# Altium schematic sheet v6_mgt.SchDoc: Virtex-6 MGT Interfaces
size A3; Date: DO NOT USE, RATHER USE PROJ OPTIONS; DrawnBy: DO NOT USE, RATHER USE PROJ OPTIONS; Engineer: DO NOT USE, RATHER USE PROJ OPTIONS; Organization: DO NOT USE, RATHER USE PROJ OPTIONS; DocumentNumber: DO NOT USE, RATHER USE PROJ OPTIONS; Revision: DO NOT USE, RATHER USE PROJ OPTIONS; SheetNumber: 18; SheetTotal: 29; SCH_Sheet_Filename: v6_mgt.SchDoc; CurrentTime: DO NOT USE, RATHER USE PROJ OPTIONS; Time: DO NOT USE, RATHER USE PROJ OPTIONS; DocumentFullPathAndName: DO NOT USE, RATHER USE PROJ OPTIONS; DocumentName: DO NOT USE, RATHER USE PROJ OPTIONS; ModifiedDate: DO NOT USE, RATHER USE PROJ OPTIONS; ImagePath: DO NOT USE, RATHER USE PROJ OPTIONS
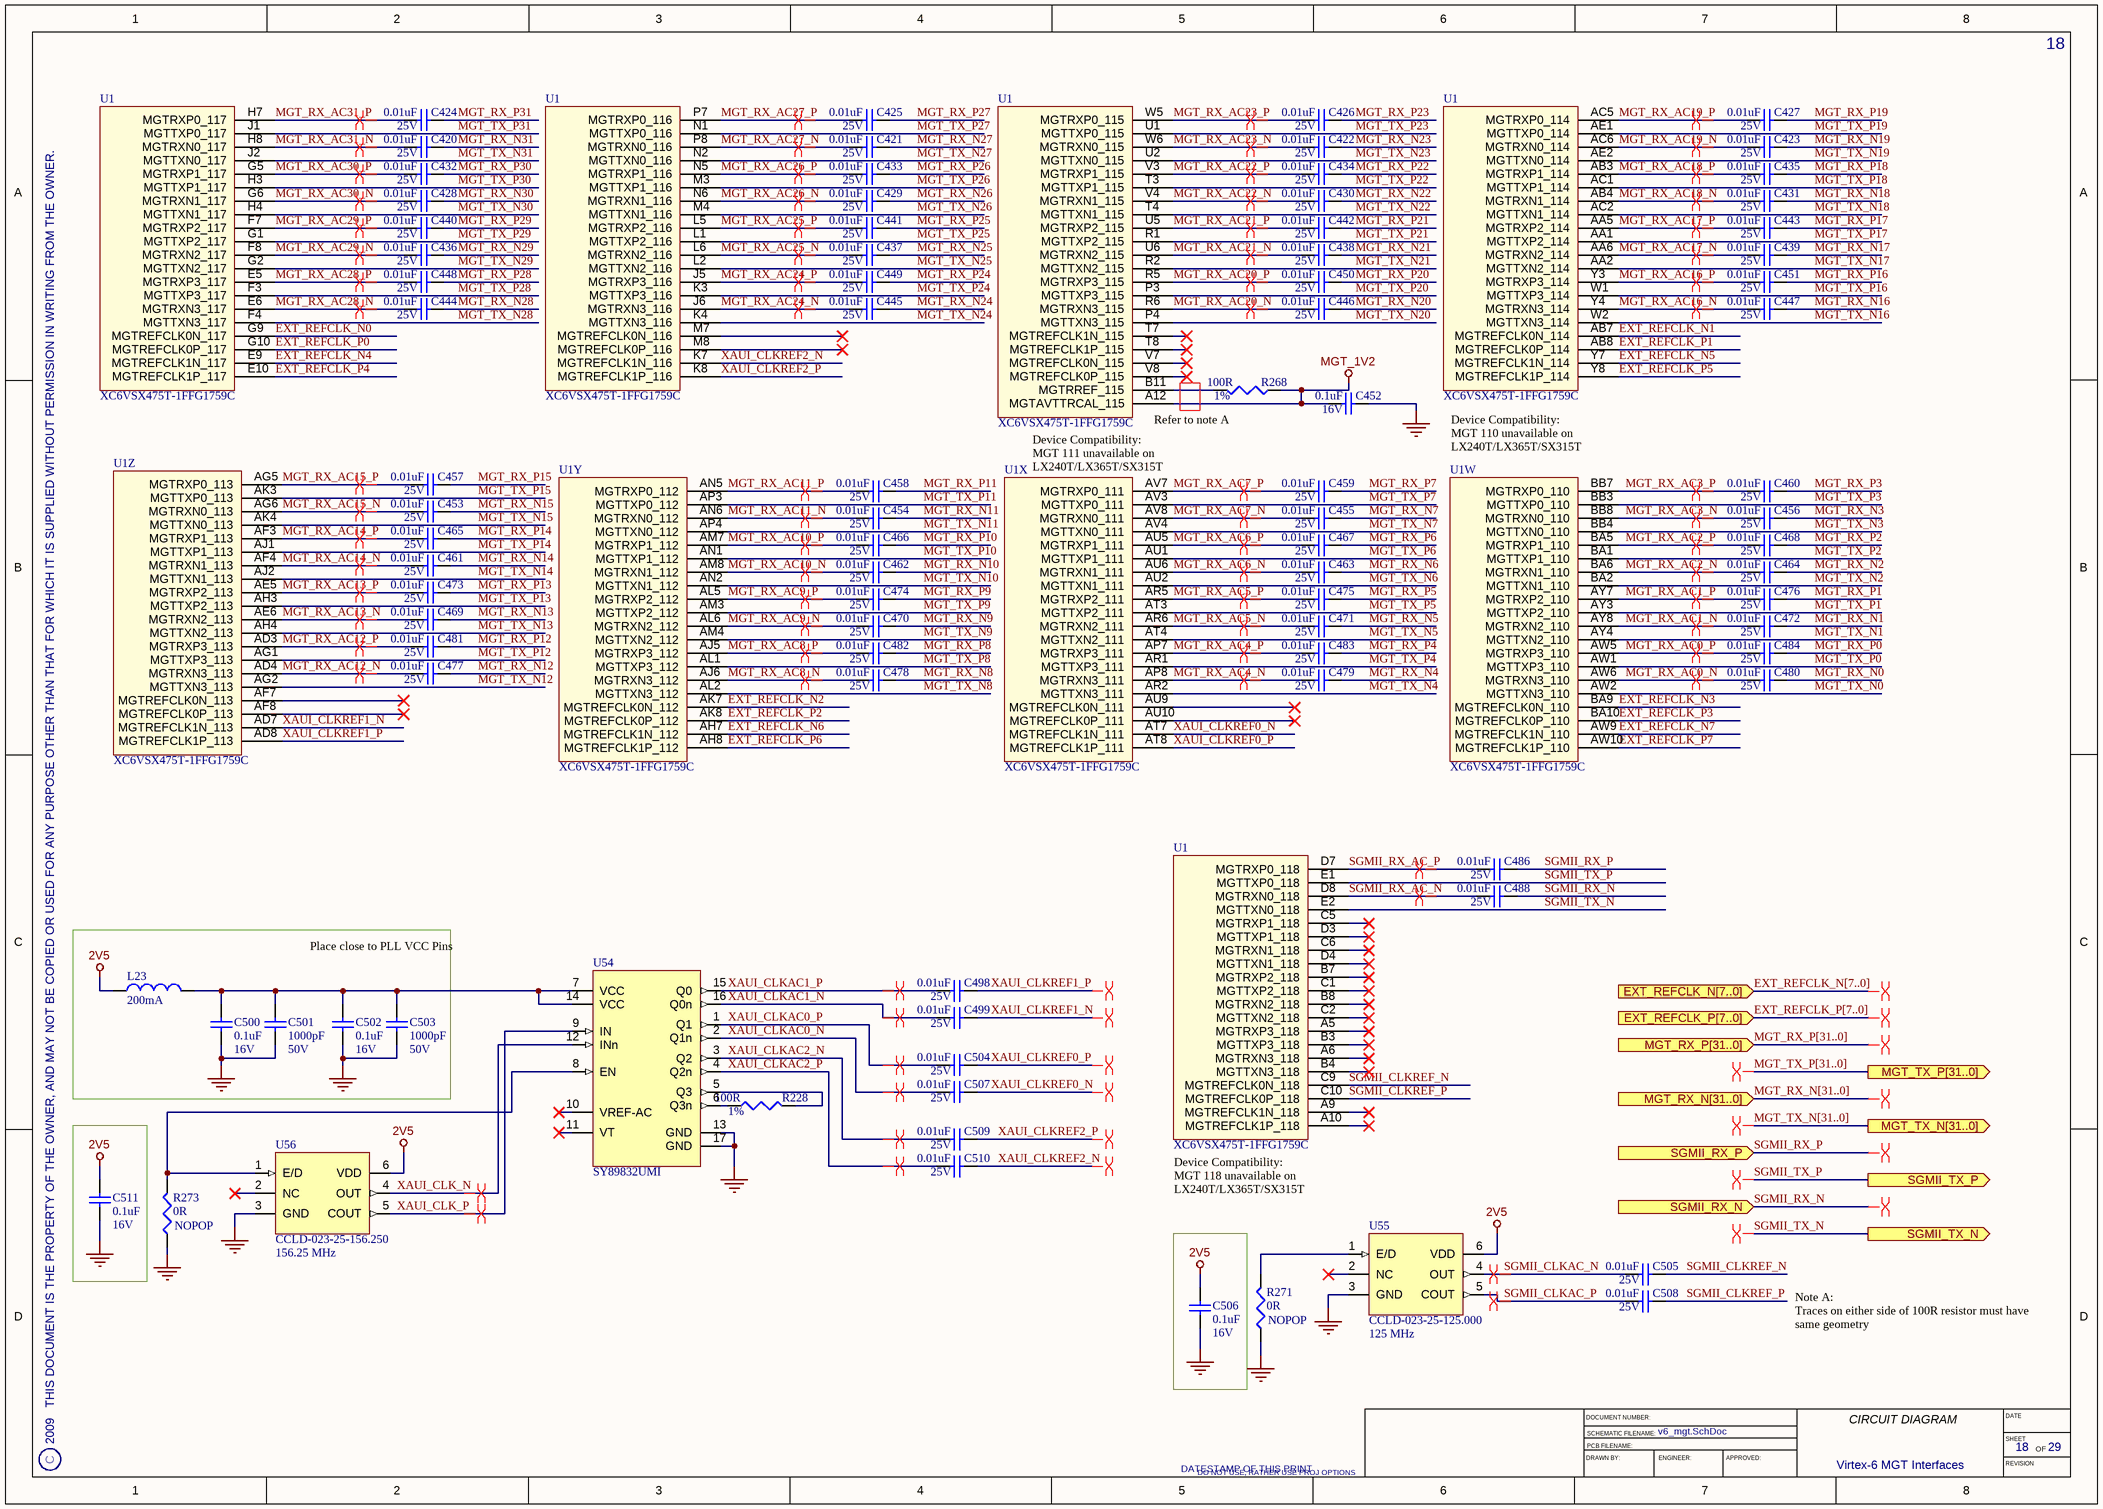
[diagram p0: v6_mgt.SchDoc]

## Parts
C420  Rating: 25V  [CAPC1005X55L]  (hidden comment: 0.01uF)
C421  Rating: 25V  [CAPC1005X55L]  (hidden comment: 0.01uF)
C422  Rating: 25V  [CAPC1005X55L]  (hidden comment: 0.01uF)
C423  Rating: 25V  [CAPC1005X55L]  (hidden comment: 0.01uF)
C424  Rating: 25V  [CAPC1005X55L]  (hidden comment: 0.01uF)
C425  Rating: 25V  [CAPC1005X55L]  (hidden comment: 0.01uF)
C426  Rating: 25V  [CAPC1005X55L]  (hidden comment: 0.01uF)
C427  Rating: 25V  [CAPC1005X55L]  (hidden comment: 0.01uF)
C428  Rating: 25V  [CAPC1005X55L]  (hidden comment: 0.01uF)
C429  Rating: 25V  [CAPC1005X55L]  (hidden comment: 0.01uF)
C430  Rating: 25V  [CAPC1005X55L]  (hidden comment: 0.01uF)
C431  Rating: 25V  [CAPC1005X55L]  (hidden comment: 0.01uF)
C432  Rating: 25V  [CAPC1005X55L]  (hidden comment: 0.01uF)
C433  Rating: 25V  [CAPC1005X55L]  (hidden comment: 0.01uF)
C434  Rating: 25V  [CAPC1005X55L]  (hidden comment: 0.01uF)
C435  Rating: 25V  [CAPC1005X55L]  (hidden comment: 0.01uF)
C436  Rating: 25V  [CAPC1005X55L]  (hidden comment: 0.01uF)
C437  Rating: 25V  [CAPC1005X55L]  (hidden comment: 0.01uF)
C438  Rating: 25V  [CAPC1005X55L]  (hidden comment: 0.01uF)
C439  Rating: 25V  [CAPC1005X55L]  (hidden comment: 0.01uF)
C440  Rating: 25V  [CAPC1005X55L]  (hidden comment: 0.01uF)
C441  Rating: 25V  [CAPC1005X55L]  (hidden comment: 0.01uF)
C442  Rating: 25V  [CAPC1005X55L]  (hidden comment: 0.01uF)
C443  Rating: 25V  [CAPC1005X55L]  (hidden comment: 0.01uF)
C444  Rating: 25V  [CAPC1005X55L]  (hidden comment: 0.01uF)
C445  Rating: 25V  [CAPC1005X55L]  (hidden comment: 0.01uF)
C446  Rating: 25V  [CAPC1005X55L]  (hidden comment: 0.01uF)
C447  Rating: 25V  [CAPC1005X55L]  (hidden comment: 0.01uF)
C448  Rating: 25V  [CAPC1005X55L]  (hidden comment: 0.01uF)
C449  Rating: 25V  [CAPC1005X55L]  (hidden comment: 0.01uF)
C450  Rating: 25V  [CAPC1005X55L]  (hidden comment: 0.01uF)
C451  Rating: 25V  [CAPC1005X55L]  (hidden comment: 0.01uF)
C452  Rating: 16V  [CAPC1005X60L]  (hidden comment: 0.1uF)
C453  Rating: 25V  [CAPC1005X55L]  (hidden comment: 0.01uF)
C454  Rating: 25V  [CAPC1005X55L]  (hidden comment: 0.01uF)
C455  Rating: 25V  [CAPC1005X55L]  (hidden comment: 0.01uF)
C456  Rating: 25V  [CAPC1005X55L]  (hidden comment: 0.01uF)
C457  Rating: 25V  [CAPC1005X55L]  (hidden comment: 0.01uF)
C458  Rating: 25V  [CAPC1005X55L]  (hidden comment: 0.01uF)
C459  Rating: 25V  [CAPC1005X55L]  (hidden comment: 0.01uF)
C460  Rating: 25V  [CAPC1005X55L]  (hidden comment: 0.01uF)
C461  Rating: 25V  [CAPC1005X55L]  (hidden comment: 0.01uF)
C462  Rating: 25V  [CAPC1005X55L]  (hidden comment: 0.01uF)
C463  Rating: 25V  [CAPC1005X55L]  (hidden comment: 0.01uF)
C464  Rating: 25V  [CAPC1005X55L]  (hidden comment: 0.01uF)
C465  Rating: 25V  [CAPC1005X55L]  (hidden comment: 0.01uF)
C466  Rating: 25V  [CAPC1005X55L]  (hidden comment: 0.01uF)
C467  Rating: 25V  [CAPC1005X55L]  (hidden comment: 0.01uF)
C468  Rating: 25V  [CAPC1005X55L]  (hidden comment: 0.01uF)
C469  Rating: 25V  [CAPC1005X55L]  (hidden comment: 0.01uF)
C470  Rating: 25V  [CAPC1005X55L]  (hidden comment: 0.01uF)
C471  Rating: 25V  [CAPC1005X55L]  (hidden comment: 0.01uF)
C472  Rating: 25V  [CAPC1005X55L]  (hidden comment: 0.01uF)
C473  Rating: 25V  [CAPC1005X55L]  (hidden comment: 0.01uF)
C474  Rating: 25V  [CAPC1005X55L]  (hidden comment: 0.01uF)
C475  Rating: 25V  [CAPC1005X55L]  (hidden comment: 0.01uF)
C476  Rating: 25V  [CAPC1005X55L]  (hidden comment: 0.01uF)
C477  Rating: 25V  [CAPC1005X55L]  (hidden comment: 0.01uF)
C478  Rating: 25V  [CAPC1005X55L]  (hidden comment: 0.01uF)
C479  Rating: 25V  [CAPC1005X55L]  (hidden comment: 0.01uF)
C480  Rating: 25V  [CAPC1005X55L]  (hidden comment: 0.01uF)
C481  Rating: 25V  [CAPC1005X55L]  (hidden comment: 0.01uF)
C482  Rating: 25V  [CAPC1005X55L]  (hidden comment: 0.01uF)
C483  Rating: 25V  [CAPC1005X55L]  (hidden comment: 0.01uF)
C484  Rating: 25V  [CAPC1005X55L]  (hidden comment: 0.01uF)
C486  Rating: 25V  [CAPC1005X55L]  (hidden comment: 0.01uF)
C488  Rating: 25V  [CAPC1005X55L]  (hidden comment: 0.01uF)
C498  Rating: 25V  [CAPC1005X55L]  (hidden comment: 0.01uF)
C499  Rating: 25V  [CAPC1005X55L]  (hidden comment: 0.01uF)
C500  Rating: 16V  [CAPC1005X60L]  (hidden comment: 0.1uF)
C501  Rating: 50V  [CAPC1005X55L]  (hidden comment: 1000pF)
C502  Rating: 16V  [CAPC1005X60L]  (hidden comment: 0.1uF)
C503  Rating: 50V  [CAPC1005X55L]  (hidden comment: 1000pF)
C504  Rating: 25V  [CAPC1005X55L]  (hidden comment: 0.01uF)
C505  Rating: 25V  [CAPC1005X55L]  (hidden comment: 0.01uF)
C506  Rating: 16V  [CAPC1005X60L]  (hidden comment: 0.1uF)
C507  Rating: 25V  [CAPC1005X55L]  (hidden comment: 0.01uF)
C508  Rating: 25V  [CAPC1005X55L]  (hidden comment: 0.01uF)
C509  Rating: 25V  [CAPC1005X55L]  (hidden comment: 0.01uF)
C510  Rating: 25V  [CAPC1005X55L]  (hidden comment: 0.01uF)
C511  Rating: 16V  [CAPC1005X60L]  (hidden comment: 0.1uF)
L23  Rating: 200mA  [INDC2012X130L]  (hidden comment: 600R)
R228  Tolerance: 1%  [RESC1005X40L]  (hidden comment: 100R)
R268  Tolerance: 1%  [RESC1005X40L]  (hidden comment: 100R)
R271  0R  [RESC1005X40L]
R273  0R  [RESC1005X40L]
U1  XC6VSX475T-1FFG1759C  [FFG1759]  (parts W,X,Y,Z,27,28,29,30,31 of 39)
U54  SY89832UMI  [MLF-16]
U55  Frequency: 125 MHz  [CCLD-023X-XX-XXX_XXX]  (hidden comment: CCLD-023-25-125.000)
U56  Frequency: 156.25 MHz  [CCLD-023X-XX-XXX_XXX]  (hidden comment: CCLD-023-25-156.250)

## Ports
EXT_REFCLK_N[7..0] (in), EXT_REFCLK_P[7..0] (in), MGT_RX_N[31..0] (in), MGT_RX_P[31..0] (in), MGT_TX_N[31..0] (out), MGT_TX_P[31..0] (out), SGMII_RX_N (in), SGMII_RX_P (in), SGMII_TX_N (out), SGMII_TX_P (out)

## Nets
2V5: C506.2 C511.2 L23.1 U55.6(VDD) U56.6(VDD)
GND: C452.1 C500.1 C501.1 C502.1 C503.1 C506.1 C511.1 R271.1 R273.1 U54.13(GND) U54.17(GND) U55.3(GND) U56.3(GND)
MGT_1V2: C452.2 R268.1 U1.A12(MGTAVTTRCAL_115)
EXT_REFCLK_N0: U1.G9(MGTREFCLK0N_117)
EXT_REFCLK_N1: U1.AB7(MGTREFCLK0N_114)
EXT_REFCLK_N2: U1.AK7(MGTREFCLK0N_112)
EXT_REFCLK_N3: U1.BA9(MGTREFCLK0N_110)
EXT_REFCLK_N4: U1.E9(MGTREFCLK1N_117)
EXT_REFCLK_N5: U1.Y7(MGTREFCLK1N_114)
EXT_REFCLK_N6: U1.AH7(MGTREFCLK1N_112)
EXT_REFCLK_N7: U1.AW9(MGTREFCLK1N_110)
EXT_REFCLK_P0: U1.G10(MGTREFCLK0P_117)
EXT_REFCLK_P1: U1.AB8(MGTREFCLK0P_114)
EXT_REFCLK_P2: U1.AK8(MGTREFCLK0P_112)
EXT_REFCLK_P3: U1.BA10(MGTREFCLK0P_110)
EXT_REFCLK_P4: U1.E10(MGTREFCLK1P_117)
EXT_REFCLK_P5: U1.Y8(MGTREFCLK1P_114)
EXT_REFCLK_P6: U1.AH8(MGTREFCLK1P_112)
EXT_REFCLK_P7: U1.AW10(MGTREFCLK1P_110)
MGT_RX_AC0_N: C480.1 U1.AW6(MGTRXN3_110)
MGT_RX_AC0_P: C484.1 U1.AW5(MGTRXP3_110)
MGT_RX_AC1_N: C472.1 U1.AY8(MGTRXN2_110)
MGT_RX_AC1_P: C476.1 U1.AY7(MGTRXP2_110)
MGT_RX_AC2_N: C464.1 U1.BA6(MGTRXN1_110)
MGT_RX_AC2_P: C468.1 U1.BA5(MGTRXP1_110)
MGT_RX_AC3_N: C456.1 U1.BB8(MGTRXN0_110)
MGT_RX_AC3_P: C460.1 U1.BB7(MGTRXP0_110)
MGT_RX_AC4_N: C479.1 U1.AP8(MGTRXN3_111)
MGT_RX_AC4_P: C483.1 U1.AP7(MGTRXP3_111)
MGT_RX_AC5_N: C471.1 U1.AR6(MGTRXN2_111)
MGT_RX_AC5_P: C475.1 U1.AR5(MGTRXP2_111)
MGT_RX_AC6_N: C463.1 U1.AU6(MGTRXN1_111)
MGT_RX_AC6_P: C467.1 U1.AU5(MGTRXP1_111)
MGT_RX_AC7_N: C455.1 U1.AV8(MGTRXN0_111)
MGT_RX_AC7_P: C459.1 U1.AV7(MGTRXP0_111)
MGT_RX_AC8_N: C478.1 U1.AJ6(MGTRXN3_112)
MGT_RX_AC8_P: C482.1 U1.AJ5(MGTRXP3_112)
MGT_RX_AC9_N: C470.1 U1.AL6(MGTRXN2_112)
MGT_RX_AC9_P: C474.1 U1.AL5(MGTRXP2_112)
MGT_RX_AC10_N: C462.1 U1.AM8(MGTRXN1_112)
MGT_RX_AC10_P: C466.1 U1.AM7(MGTRXP1_112)
MGT_RX_AC11_N: C454.1 U1.AN6(MGTRXN0_112)
MGT_RX_AC11_P: C458.1 U1.AN5(MGTRXP0_112)
MGT_RX_AC12_N: C477.1 U1.AD4(MGTRXN3_113)
MGT_RX_AC12_P: C481.1 U1.AD3(MGTRXP3_113)
MGT_RX_AC13_N: C469.1 U1.AE6(MGTRXN2_113)
MGT_RX_AC13_P: C473.1 U1.AE5(MGTRXP2_113)
MGT_RX_AC14_N: C461.1 U1.AF4(MGTRXN1_113)
MGT_RX_AC14_P: C465.1 U1.AF3(MGTRXP1_113)
MGT_RX_AC15_N: C453.1 U1.AG6(MGTRXN0_113)
MGT_RX_AC15_P: C457.1 U1.AG5(MGTRXP0_113)
MGT_RX_AC16_N: C447.1 U1.Y4(MGTRXN3_114)
MGT_RX_AC16_P: C451.1 U1.Y3(MGTRXP3_114)
MGT_RX_AC17_N: C439.1 U1.AA6(MGTRXN2_114)
MGT_RX_AC17_P: C443.1 U1.AA5(MGTRXP2_114)
MGT_RX_AC18_N: C431.1 U1.AB4(MGTRXN1_114)
MGT_RX_AC18_P: C435.1 U1.AB3(MGTRXP1_114)
MGT_RX_AC19_N: C423.1 U1.AC6(MGTRXN0_114)
MGT_RX_AC19_P: C427.1 U1.AC5(MGTRXP0_114)
MGT_RX_AC20_N: C446.1 U1.R6(MGTRXN3_115)
MGT_RX_AC20_P: C450.1 U1.R5(MGTRXP3_115)
MGT_RX_AC21_N: C438.1 U1.U6(MGTRXN2_115)
MGT_RX_AC21_P: C442.1 U1.U5(MGTRXP2_115)
MGT_RX_AC22_N: C430.1 U1.V4(MGTRXN1_115)
MGT_RX_AC22_P: C434.1 U1.V3(MGTRXP1_115)
MGT_RX_AC23_N: C422.1 U1.W6(MGTRXN0_115)
MGT_RX_AC23_P: C426.1 U1.W5(MGTRXP0_115)
MGT_RX_AC24_N: C445.1 U1.J6(MGTRXN3_116)
MGT_RX_AC24_P: C449.1 U1.J5(MGTRXP3_116)
MGT_RX_AC25_N: C437.1 U1.L6(MGTRXN2_116)
MGT_RX_AC25_P: C441.1 U1.L5(MGTRXP2_116)
MGT_RX_AC26_N: C429.1 U1.N6(MGTRXN1_116)
MGT_RX_AC26_P: C433.1 U1.N5(MGTRXP1_116)
MGT_RX_AC27_N: C421.1 U1.P8(MGTRXN0_116)
MGT_RX_AC27_P: C425.1 U1.P7(MGTRXP0_116)
MGT_RX_AC28_N: C444.1 U1.E6(MGTRXN3_117)
MGT_RX_AC28_P: C448.1 U1.E5(MGTRXP3_117)
MGT_RX_AC29_N: C436.1 U1.F8(MGTRXN2_117)
MGT_RX_AC29_P: C440.1 U1.F7(MGTRXP2_117)
MGT_RX_AC30_N: C428.1 U1.G6(MGTRXN1_117)
MGT_RX_AC30_P: C432.1 U1.G5(MGTRXP1_117)
MGT_RX_AC31_N: C420.1 U1.H8(MGTRXN0_117)
MGT_RX_AC31_P: C424.1 U1.H7(MGTRXP0_117)
MGT_RX_N0: C480.2
MGT_RX_N1: C472.2
MGT_RX_N2: C464.2
MGT_RX_N3: C456.2
MGT_RX_N4: C479.2
MGT_RX_N5: C471.2
MGT_RX_N6: C463.2
MGT_RX_N7: C455.2
MGT_RX_N8: C478.2
MGT_RX_N9: C470.2
MGT_RX_N10: C462.2
MGT_RX_N11: C454.2
MGT_RX_N12: C477.2
MGT_RX_N13: C469.2
MGT_RX_N14: C461.2
MGT_RX_N15: C453.2
MGT_RX_N16: C447.2
MGT_RX_N17: C439.2
MGT_RX_N18: C431.2
MGT_RX_N19: C423.2
MGT_RX_N20: C446.2
MGT_RX_N21: C438.2
MGT_RX_N22: C430.2
MGT_RX_N23: C422.2
MGT_RX_N24: C445.2
MGT_RX_N25: C437.2
MGT_RX_N26: C429.2
MGT_RX_N27: C421.2
MGT_RX_N28: C444.2
MGT_RX_N29: C436.2
MGT_RX_N30: C428.2
MGT_RX_N31: C420.2
MGT_RX_P0: C484.2
MGT_RX_P1: C476.2
MGT_RX_P2: C468.2
MGT_RX_P3: C460.2
MGT_RX_P4: C483.2
MGT_RX_P5: C475.2
MGT_RX_P6: C467.2
MGT_RX_P7: C459.2
MGT_RX_P8: C482.2
MGT_RX_P9: C474.2
MGT_RX_P10: C466.2
MGT_RX_P11: C458.2
MGT_RX_P12: C481.2
MGT_RX_P13: C473.2
MGT_RX_P14: C465.2
MGT_RX_P15: C457.2
MGT_RX_P16: C451.2
MGT_RX_P17: C443.2
MGT_RX_P18: C435.2
MGT_RX_P19: C427.2
MGT_RX_P20: C450.2
MGT_RX_P21: C442.2
MGT_RX_P22: C434.2
MGT_RX_P23: C426.2
MGT_RX_P24: C449.2
MGT_RX_P25: C441.2
MGT_RX_P26: C433.2
MGT_RX_P27: C425.2
MGT_RX_P28: C448.2
MGT_RX_P29: C440.2
MGT_RX_P30: C432.2
MGT_RX_P31: C424.2
MGT_TX_N0: U1.AW2(MGTTXN3_110)
MGT_TX_N1: U1.AY4(MGTTXN2_110)
MGT_TX_N2: U1.BA2(MGTTXN1_110)
MGT_TX_N3: U1.BB4(MGTTXN0_110)
MGT_TX_N4: U1.AR2(MGTTXN3_111)
MGT_TX_N5: U1.AT4(MGTTXN2_111)
MGT_TX_N6: U1.AU2(MGTTXN1_111)
MGT_TX_N7: U1.AV4(MGTTXN0_111)
MGT_TX_N8: U1.AL2(MGTTXN3_112)
MGT_TX_N9: U1.AM4(MGTTXN2_112)
MGT_TX_N10: U1.AN2(MGTTXN1_112)
MGT_TX_N11: U1.AP4(MGTTXN0_112)
MGT_TX_N12: U1.AG2(MGTTXN3_113)
MGT_TX_N13: U1.AH4(MGTTXN2_113)
MGT_TX_N14: U1.AJ2(MGTTXN1_113)
MGT_TX_N15: U1.AK4(MGTTXN0_113)
MGT_TX_N16: U1.W2(MGTTXN3_114)
MGT_TX_N17: U1.AA2(MGTTXN2_114)
MGT_TX_N18: U1.AC2(MGTTXN1_114)
MGT_TX_N19: U1.AE2(MGTTXN0_114)
MGT_TX_N20: U1.P4(MGTTXN3_115)
MGT_TX_N21: U1.R2(MGTTXN2_115)
MGT_TX_N22: U1.T4(MGTTXN1_115)
MGT_TX_N23: U1.U2(MGTTXN0_115)
MGT_TX_N24: U1.K4(MGTTXN3_116)
MGT_TX_N25: U1.L2(MGTTXN2_116)
MGT_TX_N26: U1.M4(MGTTXN1_116)
MGT_TX_N27: U1.N2(MGTTXN0_116)
MGT_TX_N28: U1.F4(MGTTXN3_117)
MGT_TX_N29: U1.G2(MGTTXN2_117)
MGT_TX_N30: U1.H4(MGTTXN1_117)
MGT_TX_N31: U1.J2(MGTTXN0_117)
MGT_TX_P0: U1.AW1(MGTTXP3_110)
MGT_TX_P1: U1.AY3(MGTTXP2_110)
MGT_TX_P2: U1.BA1(MGTTXP1_110)
MGT_TX_P3: U1.BB3(MGTTXP0_110)
MGT_TX_P4: U1.AR1(MGTTXP3_111)
MGT_TX_P5: U1.AT3(MGTTXP2_111)
MGT_TX_P6: U1.AU1(MGTTXP1_111)
MGT_TX_P7: U1.AV3(MGTTXP0_111)
MGT_TX_P8: U1.AL1(MGTTXP3_112)
MGT_TX_P9: U1.AM3(MGTTXP2_112)
MGT_TX_P10: U1.AN1(MGTTXP1_112)
MGT_TX_P11: U1.AP3(MGTTXP0_112)
MGT_TX_P12: U1.AG1(MGTTXP3_113)
MGT_TX_P13: U1.AH3(MGTTXP2_113)
MGT_TX_P14: U1.AJ1(MGTTXP1_113)
MGT_TX_P15: U1.AK3(MGTTXP0_113)
MGT_TX_P16: U1.W1(MGTTXP3_114)
MGT_TX_P17: U1.AA1(MGTTXP2_114)
MGT_TX_P18: U1.AC1(MGTTXP1_114)
MGT_TX_P19: U1.AE1(MGTTXP0_114)
MGT_TX_P20: U1.P3(MGTTXP3_115)
MGT_TX_P21: U1.R1(MGTTXP2_115)
MGT_TX_P22: U1.T3(MGTTXP1_115)
MGT_TX_P23: U1.U1(MGTTXP0_115)
MGT_TX_P24: U1.K3(MGTTXP3_116)
MGT_TX_P25: U1.L1(MGTTXP2_116)
MGT_TX_P26: U1.M3(MGTTXP1_116)
MGT_TX_P27: U1.N1(MGTTXP0_116)
MGT_TX_P28: U1.F3(MGTTXP3_117)
MGT_TX_P29: U1.G1(MGTTXP2_117)
MGT_TX_P30: U1.H3(MGTTXP1_117)
MGT_TX_P31: U1.J1(MGTTXP0_117)
SGMII_CLKAC_N: C505.1 U55.4(OUT)
SGMII_CLKAC_P: C508.1 U55.5(COUT)
SGMII_CLKREF_N: C505.2 U1.C9(MGTREFCLK0N_118)
SGMII_CLKREF_P: C508.2 U1.C10(MGTREFCLK0P_118)
SGMII_RX_AC_N: C488.1 U1.D8(MGTRXN0_118)
SGMII_RX_AC_P: C486.1 U1.D7(MGTRXP0_118)
SGMII_RX_N: C488.2 ; port SGMII_RX_N
SGMII_RX_P: C486.2 ; port SGMII_RX_P
SGMII_TX_N: U1.E2(MGTTXN0_118) ; port SGMII_TX_N
SGMII_TX_P: U1.E1(MGTTXP0_118) ; port SGMII_TX_P
XAUI_CLK_N: U54.12(INn) U56.4(OUT)
XAUI_CLK_P: U54.9(IN) U56.5(COUT)
XAUI_CLKAC0_N: C507.1 U54.2(Q1n)
XAUI_CLKAC0_P: C504.1 U54.1(Q1)
XAUI_CLKAC1_N: C499.1 U54.16(Q0n)
XAUI_CLKAC1_P: C498.1 U54.15(Q0)
XAUI_CLKAC2_N: C509.1 U54.3(Q2)
XAUI_CLKAC2_P: C510.1 U54.4(Q2n)
XAUI_CLKREF0_N: C507.2 U1.AT7(MGTREFCLK1N_111)
XAUI_CLKREF0_P: C504.2 U1.AT8(MGTREFCLK1P_111)
XAUI_CLKREF1_N: C499.2 U1.AD7(MGTREFCLK1N_113)
XAUI_CLKREF1_P: C498.2 U1.AD8(MGTREFCLK1P_113)
XAUI_CLKREF2_N: C510.2 U1.K7(MGTREFCLK1N_116)
XAUI_CLKREF2_P: C509.2 U1.K8(MGTREFCLK1P_116)
NetC500_2: C500.2 C501.2 C502.2 C503.2 L23.2 U54.7(VCC) U54.14(VCC)
NetR228_1: R228.1 U54.6(Q3n)
NetR228_2: R228.2 U54.5(Q3)
NetR268_2: R268.2 U1.B11(MGTRREF_115)
NetR271_2: R271.2 U55.1(E/D)
NetR273_2: R273.2 U54.8(EN) U56.1(E/D)

Not connected (* = marked no-connect by the designer): U1 A5(MGTRXP3_118)* A6(MGTRXN3_118)* A9(MGTREFCLK1N_118)* A10(MGTREFCLK1P_118)* AF7(MGTREFCLK0N_113)* AF8(MGTREFCLK0P_113)* AU9(MGTREFCLK0N_111)* AU10(MGTREFCLK0P_111)* B3(MGTTXP3_118)* B4(MGTTXN3_118)* B7(MGTRXP2_118)* B8(MGTRXN2_118)* C1(MGTTXP2_118)* C2(MGTTXN2_118)* C5(MGTRXP1_118)* C6(MGTRXN1_118)* D3(MGTTXP1_118)* D4(MGTTXN1_118)* M7(MGTREFCLK0N_116)* M8(MGTREFCLK0P_116)* T7(MGTREFCLK1N_115)* T8(MGTREFCLK1P_115)* V7(MGTREFCLK0N_115)* V8(MGTREFCLK0P_115)*; U54 10(VREF-AC)* 11(VT)*; U55 2(NC)*; U56 2(NC)*

## Buses and harness runs
bus EXT_REFCLK_N[7..0] = port EXT_REFCLK_N[7..0]
bus EXT_REFCLK_P[7..0] = port EXT_REFCLK_P[7..0]
bus MGT_RX_N[31..0] = port MGT_RX_N[31..0]
bus MGT_RX_P[31..0] = port MGT_RX_P[31..0]
bus MGT_TX_N[31..0] = port MGT_TX_N[31..0]
bus MGT_TX_P[31..0] = port MGT_TX_P[31..0]

## Layout directives
differential pair: (no net found under the mark), MGT_RX_AC0_N, MGT_RX_AC0_P, MGT_RX_AC1_N, MGT_RX_AC1_P, MGT_RX_AC2_N, MGT_RX_AC2_P, MGT_RX_AC3_N, MGT_RX_AC3_P, MGT_RX_AC4_N, MGT_RX_AC4_P, MGT_RX_AC5_N, MGT_RX_AC5_P, MGT_RX_AC6_N, MGT_RX_AC6_P, MGT_RX_AC7_N, MGT_RX_AC7_P, MGT_RX_AC8_N, MGT_RX_AC8_P, MGT_RX_AC9_N, MGT_RX_AC9_P, MGT_RX_AC10_N, MGT_RX_AC10_P, MGT_RX_AC11_N, MGT_RX_AC11_P, MGT_RX_AC12_N, MGT_RX_AC12_P, MGT_RX_AC13_N, MGT_RX_AC13_P, MGT_RX_AC14_N, MGT_RX_AC14_P, MGT_RX_AC15_N, MGT_RX_AC15_P, MGT_RX_AC16_N, MGT_RX_AC16_P, MGT_RX_AC17_N, MGT_RX_AC17_P, MGT_RX_AC18_N, MGT_RX_AC18_P, MGT_RX_AC19_N, MGT_RX_AC19_P, MGT_RX_AC20_N, MGT_RX_AC20_P, MGT_RX_AC21_N, MGT_RX_AC21_P, MGT_RX_AC22_N, MGT_RX_AC22_P, MGT_RX_AC23_N, MGT_RX_AC23_P, MGT_RX_AC24_N, MGT_RX_AC24_P, MGT_RX_AC25_N, MGT_RX_AC25_P, MGT_RX_AC26_N, MGT_RX_AC26_P, MGT_RX_AC27_N, MGT_RX_AC27_P, MGT_RX_AC28_N, MGT_RX_AC28_P, MGT_RX_AC29_N, MGT_RX_AC29_P, MGT_RX_AC30_N, MGT_RX_AC30_P, MGT_RX_AC31_N, MGT_RX_AC31_P, SGMII_CLKAC_N, SGMII_CLKAC_P, SGMII_RX_AC_N, SGMII_RX_AC_P, SGMII_RX_N, SGMII_RX_P, SGMII_TX_N, SGMII_TX_P, XAUI_CLK_N, XAUI_CLK_P, XAUI_CLKAC0_N, XAUI_CLKAC0_P, XAUI_CLKAC1_N, XAUI_CLKAC1_P, XAUI_CLKAC2_N, XAUI_CLKAC2_P, XAUI_CLKREF0_N, XAUI_CLKREF0_P, XAUI_CLKREF1_N, XAUI_CLKREF1_P, XAUI_CLKREF2_N, XAUI_CLKREF2_P

## Notes on the sheet
- Refer to note A
- (near U1) Device Compatibility:
  MGT 110 unavailable on LX240T/LX365T/SX315T
- (near U1) Device Compatibility:
  MGT 111 unavailable on LX240T/LX365T/SX315T
- Place close to PLL VCC Pins
- (near R273) NOPOP
- (near U1) Device Compatibility:
  MGT 118 unavailable on LX240T/LX365T/SX315T
- (near R271) NOPOP
- Note A:
  Traces on either side of 100R resistor must have same geometry
- 2009   THIS DOCUMENT IS THE PROPERTY OF THE OWNER, AND MAY NOT BE COPIED OR USED FOR ANY PURPOSE OTHER THAN THAT FOR WHICH IT IS SUPPLIED WITHOUT PERMISSION IN WRITING FROM THE OWNER.
- C
- DATESTAMP OF THIS PRINT
- DRAWN BY:
- DOCUMENT NUMBER:
- SCHEMATIC FILENAME:
- PCB FILENAME:
- ENGINEER:
- APPROVED:
- CIRCUIT DIAGRAM
- DATE
- SHEET
- REVISION
- OF

## Library data of the parts
C420-C451 C453-C484 C486 C488 C498 C499 C504 C505 C507-C510 = CAP-CER-6: 0.01uF, Ceramic Capacitor; Manufacturer: MURATA; PartNum: GRM155R71E103KA01D; Tolerance: 10%; Dielectric: X7R; POD number: CAP-CER-6; Value: 0.01uF; RoHS: Y; Sort Value: 0.01; Category: Capacitors; Subcategory: Ceramic
C452 C500 C502 C506 C511 = CAP-CER-1: 0.1uF, Ceramic Capacitor; Manufacturer: VENKEL; PartNum: C0402X7R160-104KN; Tolerance: 10%; Dielectric: X7R; POD number: CAP-CER-1; Value: 0.1uF; RoHS: Y; Sort Value: 0.1; Category: Capacitors; Subcategory: Ceramic
C501 C503 = CAP-CER-4: 1000pF, Ceramic Capacitor; Manufacturer: MURATA; PartNum: GRM155R61H102KA01D; Tolerance: 10%; Dielectric: X5R; POD number: CAP-CER-4; Value: 1000pF; RoHS: Y; Sort Value: 0.0001; Category: Capacitors; Subcategory: Ceramic
L23 = IND-FB-0: 600 Ohm, Chip Ferrite Bead; Manufacturer: Murata; PartNum: BLM21BD601SN1; DC Res: 0.35R; Tolerance: 25%; POD number: IND-FB-0; RoHS: Y; Value: 600R; Sort Value: 600; Category: Inductors; Subcategory: FerriteBead
R228 R268 = RES-TF-14: 100R, 1.1mm x 0.5mm, Thick Film Resistor; Manufacturer: ROYALOHM; PartNum: 0402WGF0101T1E; Rating: 0.0625W; POD number: RES-TF-14; Value: 100R; Sort Value: 1000; Category: Resistors; Subcategory: ThickFilm; HelpURL: *.pdf
R271 R273 = RES-TF-0: 0R, 1.1mm x 0.5mm, Thick Film Resistor; Manufacturer: ROYALOHM; PartNum: 0402WG00000T1E; Tolerance: 0%; Rating: 0.0625W; POD number: RES-TF-0; Value: 0R; Sort Value: 0; Category: Resistors; Subcategory: ThickFilm; HelpURL: *.pdf
U1 = IC-PLD-0: Virtex-6 475SXT 1760-pin FPGA; Manufacturer: Xilinx; POD number: IC-PLD-0; PartNum: XC6VSX475T-1FFG1759C; RoHS: Y; Category: IC; Subcategory: PLD
U54 = IC-LOG-14: 2.5 C Ultra-precision 1:4 LVDS Fanout Buffer/Translator with Interal Termination; Manufacturer: Micrel; POD number: IC-LOG-14; PartNum: SY89832UMI; RoHS: Y; Category: IC; Subcategory: Logic
U55 = RESN-CLK-3: 125.00 MHz, Low-Jitter Differential LVDS Clock Oscillator; Manufacturer: Crystek; Stability: 25 PPM; POD number: RESN-CLK-3; PartNum: CCLD-023-25-125.000; RoHS: Y; Category: RESN; Subcategory: Clock Oscillators
U56 = RESN-CLK-4: 156.25 MHz, Low-Jitter Differential LVDS Clock Oscillator; Manufacturer: Crystek; Stability: 25 PPM; POD number: RESN-CLK-4; PartNum: CCLD-023-25-156.250; RoHS: Y; Category: RESN; Subcategory: Clock Oscillators